# EAGLE schematic Resistor_Resistor (EAGLE 8.3.0), part 39 of 43
## Nets (continued)
N$147: R27401.2 R27402.2 R27403.2 R27404.2 R27405.2 R27406.2 R27407.2 R27408.2 R27409.2 R27410.2 R27411.2 R27412.2 R27413.2 R27414.2 R27415.2 R27416.2 R27417.2 R27418.2 R27419.2 R27420.2 R27421.2 R27422.2 R27423.2 R27424.2 R27425.2 R27426.2 R27427.2 R27428.2 R27429.2 R27430.2 R27431.2 R27432.2 R27433.2 R27434.2 R27435.2 R27436.2 R27437.2 R27438.2 R27439.2 R27440.2 R27441.2 R27442.2 R27443.2 R27444.2 R27445.2 R27446.2 R27447.2 R27448.2 R27449.2 R27450.2 R27451.2 R27452.2 R27453.2 R27454.2 R27455.2 R27456.2 R27457.2 R27458.2 R27459.2 R27460.2 R27461.2 R27462.2 R27463.2 R27464.2 R27465.2 R27466.2 R27467.2 R27468.2 R27469.2 R27470.2 R27471.2 R27472.2 R27473.2 R27474.2 R27475.2 R27476.2 R27477.2 R27478.2 R27479.2 R27480.2 R27481.2 R27482.2 R27483.2 R27484.2 R27485.2 R27486.2 R27487.2 R27488.2 R27489.2 R27490.2 R27491.2 R27492.2 R27493.2 R27494.2 R27495.2 R27496.2 R27497.2 R27498.2 R27499.2 R27500.2 R27501.2 R27502.2 R27503.2 R27504.2 R27505.2 R27506.2 R27507.2 R27508.2 R27509.2 R27510.2 R27511.2 R27512.2 R27513.2 R27514.2 R27515.2 R27516.2 R27517.2 R27518.2 R27519.2 R27520.2 R27521.2 R27522.2 R27523.2 R27524.2 R27525.2 R27526.2 R27527.2 R27528.2 R27529.2 R27530.2 R27531.2 R27532.2 R27533.2 R27534.2 R27535.2 R27536.2 R27537.2 R27538.2 R27539.2 R27540.2 R27541.2 R27542.2 R27543.2 R27544.2 R27545.2 R27546.2 R27547.2 R27548.2 R27549.2 R27550.2 R27551.2 R27552.2 R27553.2 R27554.2 R27555.2 R27556.2 R27557.2 R27558.2 R27559.2 R27560.2 R27561.2 R27562.2 R27563.2 R27564.2 R27565.2 R27566.2 R27567.2 R27568.2 R27569.2 R27570.2 R27571.2 R27572.2 R27573.2 R27574.2 R27575.2 R27576.2 R27577.2 R27578.2 R27579.2 R27580.2 R27581.2 R27582.2 R27583.2 R27584.2 R27585.2 R27586.2 R27587.2 R27588.2 R27589.2 R27590.2 R27591.2 R27592.2 R27593.2 R27594.2 R27595.2 R27596.2 R27597.2 R27598.2 R27599.2 R27600.2 R27601.1 R27602.1 R27603.1 R27604.1 R27605.1 R27606.1 R27607.1 R27608.1 R27609.1 R27610.1 R27611.1 R27612.1 R27613.1 R27614.1 R27615.1 R27616.1 R27617.1 R27618.1 R27619.1 R27620.1 R27621.1 R27622.1 R27623.1 R27624.1 R27625.1 R27626.1 R27627.1 R27628.1 R27629.1 R27630.1 R27631.1 R27632.1 R27633.1 R27634.1 R27635.1 R27636.1 R27637.1 R27638.1 R27639.1 R27640.1 R27641.1 R27642.1 R27643.1 R27644.1 R27645.1 R27646.1 R27647.1 R27648.1 R27649.1 R27650.1 R27651.1 R27652.1 R27653.1 R27654.1 R27655.1 R27656.1 R27657.1 R27658.1 R27659.1 R27660.1 R27661.1 R27662.1 R27663.1 R27664.1 R27665.1 R27666.1 R27667.1 R27668.1 R27669.1 R27670.1 R27671.1 R27672.1 R27673.1 R27674.1 R27675.1 R27676.1 R27677.1 R27678.1 R27679.1 R27680.1 R27681.1 R27682.1 R27683.1 R27684.1 R27685.1 R27686.1 R27687.1 R27688.1 R27689.1 R27690.1 R27691.1 R27692.1 R27693.1 R27694.1 R27695.1 R27696.1 R27697.1 R27698.1 R27699.1 R27700.1 R27701.1 R27702.1 R27703.1 R27704.1 R27705.1 R27706.1 R27707.1 R27708.1 R27709.1 R27710.1 R27711.1 R27712.1 R27713.1 R27714.1 R27715.1 R27716.1 R27717.1 R27718.1 R27719.1 R27720.1 R27721.1 R27722.1 R27723.1 R27724.1 R27725.1 R27726.1 R27727.1 R27728.1 R27729.1 R27730.1 R27731.1 R27732.1 R27733.1 R27734.1 R27735.1 R27736.1 R27737.1 R27738.1 R27739.1 R27740.1 R27741.1 R27742.1 R27743.1 R27744.1 R27745.1 R27746.1 R27747.1 R27748.1 R27749.1 R27750.1 R27751.1 R27752.1 R27753.1 R27754.1 R27755.1 R27756.1 R27757.1 R27758.1 R27759.1 R27760.1 R27761.1 R27762.1 R27763.1 R27764.1 R27765.1 R27766.1 R27767.1 R27768.1 R27769.1 R27770.1 R27771.1 R27772.1 R27773.1 R27774.1 R27775.1 R27776.1 R27777.1 R27778.1 R27779.1 R27780.1 R27781.1 R27782.1 R27783.1 R27784.1 R27785.1 R27786.1 R27787.1 R27788.1 R27789.1 R27790.1 R27791.1 R27792.1 R27793.1 R27794.1 R27795.1 R27796.1 R27797.1 R27798.1 R27799.1 R27800.1
N$148: R27601.2 R27602.2 R27603.2 R27604.2 R27605.2 R27606.2 R27607.2 R27608.2 R27609.2 R27610.2 R27611.2 R27612.2 R27613.2 R27614.2 R27615.2 R27616.2 R27617.2 R27618.2 R27619.2 R27620.2 R27621.2 R27622.2 R27623.2 R27624.2 R27625.2 R27626.2 R27627.2 R27628.2 R27629.2 R27630.2 R27631.2 R27632.2 R27633.2 R27634.2 R27635.2 R27636.2 R27637.2 R27638.2 R27639.2 R27640.2 R27641.2 R27642.2 R27643.2 R27644.2 R27645.2 R27646.2 R27647.2 R27648.2 R27649.2 R27650.2 R27651.2 R27652.2 R27653.2 R27654.2 R27655.2 R27656.2 R27657.2 R27658.2 R27659.2 R27660.2 R27661.2 R27662.2 R27663.2 R27664.2 R27665.2 R27666.2 R27667.2 R27668.2 R27669.2 R27670.2 R27671.2 R27672.2 R27673.2 R27674.2 R27675.2 R27676.2 R27677.2 R27678.2 R27679.2 R27680.2 R27681.2 R27682.2 R27683.2 R27684.2 R27685.2 R27686.2 R27687.2 R27688.2 R27689.2 R27690.2 R27691.2 R27692.2 R27693.2 R27694.2 R27695.2 R27696.2 R27697.2 R27698.2 R27699.2 R27700.2 R27701.2 R27702.2 R27703.2 R27704.2 R27705.2 R27706.2 R27707.2 R27708.2 R27709.2 R27710.2 R27711.2 R27712.2 R27713.2 R27714.2 R27715.2 R27716.2 R27717.2 R27718.2 R27719.2 R27720.2 R27721.2 R27722.2 R27723.2 R27724.2 R27725.2 R27726.2 R27727.2 R27728.2 R27729.2 R27730.2 R27731.2 R27732.2 R27733.2 R27734.2 R27735.2 R27736.2 R27737.2 R27738.2 R27739.2 R27740.2 R27741.2 R27742.2 R27743.2 R27744.2 R27745.2 R27746.2 R27747.2 R27748.2 R27749.2 R27750.2 R27751.2 R27752.2 R27753.2 R27754.2 R27755.2 R27756.2 R27757.2 R27758.2 R27759.2 R27760.2 R27761.2 R27762.2 R27763.2 R27764.2 R27765.2 R27766.2 R27767.2 R27768.2 R27769.2 R27770.2 R27771.2 R27772.2 R27773.2 R27774.2 R27775.2 R27776.2 R27777.2 R27778.2 R27779.2 R27780.2 R27781.2 R27782.2 R27783.2 R27784.2 R27785.2 R27786.2 R27787.2 R27788.2 R27789.2 R27790.2 R27791.2 R27792.2 R27793.2 R27794.2 R27795.2 R27796.2 R27797.2 R27798.2 R27799.2 R27800.2 R27801.1 R27802.1 R27803.1 R27804.1 R27805.1 R27806.1 R27807.1 R27808.1 R27809.1 R27810.1 R27811.1 R27812.1 R27813.1 R27814.1 R27815.1 R27816.1 R27817.1 R27818.1 R27819.1 R27820.1 R27821.1 R27822.1 R27823.1 R27824.1 R27825.1 R27826.1 R27827.1 R27828.1 R27829.1 R27830.1 R27831.1 R27832.1 R27833.1 R27834.1 R27835.1 R27836.1 R27837.1 R27838.1 R27839.1 R27840.1 R27841.1 R27842.1 R27843.1 R27844.1 R27845.1 R27846.1 R27847.1 R27848.1 R27849.1 R27850.1 R27851.1 R27852.1 R27853.1 R27854.1 R27855.1 R27856.1 R27857.1 R27858.1 R27859.1 R27860.1 R27861.1 R27862.1 R27863.1 R27864.1 R27865.1 R27866.1 R27867.1 R27868.1 R27869.1 R27870.1 R27871.1 R27872.1 R27873.1 R27874.1 R27875.1 R27876.1 R27877.1 R27878.1 R27879.1 R27880.1 R27881.1 R27882.1 R27883.1 R27884.1 R27885.1 R27886.1 R27887.1 R27888.1 R27889.1 R27890.1 R27891.1 R27892.1 R27893.1 R27894.1 R27895.1 R27896.1 R27897.1 R27898.1 R27899.1 R27900.1 R27901.1 R27902.1 R27903.1 R27904.1 R27905.1 R27906.1 R27907.1 R27908.1 R27909.1 R27910.1 R27911.1 R27912.1 R27913.1 R27914.1 R27915.1 R27916.1 R27917.1 R27918.1 R27919.1 R27920.1 R27921.1 R27922.1 R27923.1 R27924.1 R27925.1 R27926.1 R27927.1 R27928.1 R27929.1 R27930.1 R27931.1 R27932.1 R27933.1 R27934.1 R27935.1 R27936.1 R27937.1 R27938.1 R27939.1 R27940.1 R27941.1 R27942.1 R27943.1 R27944.1 R27945.1 R27946.1 R27947.1 R27948.1 R27949.1 R27950.1 R27951.1 R27952.1 R27953.1 R27954.1 R27955.1 R27956.1 R27957.1 R27958.1 R27959.1 R27960.1 R27961.1 R27962.1 R27963.1 R27964.1 R27965.1 R27966.1 R27967.1 R27968.1 R27969.1 R27970.1 R27971.1 R27972.1 R27973.1 R27974.1 R27975.1 R27976.1 R27977.1 R27978.1 R27979.1 R27980.1 R27981.1 R27982.1 R27983.1 R27984.1 R27985.1 R27986.1 R27987.1 R27988.1 R27989.1 R27990.1 R27991.1 R27992.1 R27993.1 R27994.1 R27995.1 R27996.1 R27997.1 R27998.1 R27999.1 R28000.1
N$149: R27801.2 R27802.2 R27803.2 R27804.2 R27805.2 R27806.2 R27807.2 R27808.2 R27809.2 R27810.2 R27811.2 R27812.2 R27813.2 R27814.2 R27815.2 R27816.2 R27817.2 R27818.2 R27819.2 R27820.2 R27821.2 R27822.2 R27823.2 R27824.2 R27825.2 R27826.2 R27827.2 R27828.2 R27829.2 R27830.2 R27831.2 R27832.2 R27833.2 R27834.2 R27835.2 R27836.2 R27837.2 R27838.2 R27839.2 R27840.2 R27841.2 R27842.2 R27843.2 R27844.2 R27845.2 R27846.2 R27847.2 R27848.2 R27849.2 R27850.2 R27851.2 R27852.2 R27853.2 R27854.2 R27855.2 R27856.2 R27857.2 R27858.2 R27859.2 R27860.2 R27861.2 R27862.2 R27863.2 R27864.2 R27865.2 R27866.2 R27867.2 R27868.2 R27869.2 R27870.2 R27871.2 R27872.2 R27873.2 R27874.2 R27875.2 R27876.2 R27877.2 R27878.2 R27879.2 R27880.2 R27881.2 R27882.2 R27883.2 R27884.2 R27885.2 R27886.2 R27887.2 R27888.2 R27889.2 R27890.2 R27891.2 R27892.2 R27893.2 R27894.2 R27895.2 R27896.2 R27897.2 R27898.2 R27899.2 R27900.2 R27901.2 R27902.2 R27903.2 R27904.2 R27905.2 R27906.2 R27907.2 R27908.2 R27909.2 R27910.2 R27911.2 R27912.2 R27913.2 R27914.2 R27915.2 R27916.2 R27917.2 R27918.2 R27919.2 R27920.2 R27921.2 R27922.2 R27923.2 R27924.2 R27925.2 R27926.2 R27927.2 R27928.2 R27929.2 R27930.2 R27931.2 R27932.2 R27933.2 R27934.2 R27935.2 R27936.2 R27937.2 R27938.2 R27939.2 R27940.2 R27941.2 R27942.2 R27943.2 R27944.2 R27945.2 R27946.2 R27947.2 R27948.2 R27949.2 R27950.2 R27951.2 R27952.2 R27953.2 R27954.2 R27955.2 R27956.2 R27957.2 R27958.2 R27959.2 R27960.2 R27961.2 R27962.2 R27963.2 R27964.2 R27965.2 R27966.2 R27967.2 R27968.2 R27969.2 R27970.2 R27971.2 R27972.2 R27973.2 R27974.2 R27975.2 R27976.2 R27977.2 R27978.2 R27979.2 R27980.2 R27981.2 R27982.2 R27983.2 R27984.2 R27985.2 R27986.2 R27987.2 R27988.2 R27989.2 R27990.2 R27991.2 R27992.2 R27993.2 R27994.2 R27995.2 R27996.2 R27997.2 R27998.2 R27999.2 R28000.2 R28001.1 R28002.1 R28003.1 R28004.1 R28005.1 R28006.1 R28007.1 R28008.1 R28009.1 R28010.1 R28011.1 R28012.1 R28013.1 R28014.1 R28015.1 R28016.1 R28017.1 R28018.1 R28019.1 R28020.1 R28021.1 R28022.1 R28023.1 R28024.1 R28025.1 R28026.1 R28027.1 R28028.1 R28029.1 R28030.1 R28031.1 R28032.1 R28033.1 R28034.1 R28035.1 R28036.1 R28037.1 R28038.1 R28039.1 R28040.1 R28041.1 R28042.1 R28043.1 R28044.1 R28045.1 R28046.1 R28047.1 R28048.1 R28049.1 R28050.1 R28051.1 R28052.1 R28053.1 R28054.1 R28055.1 R28056.1 R28057.1 R28058.1 R28059.1 R28060.1 R28061.1 R28062.1 R28063.1 R28064.1 R28065.1 R28066.1 R28067.1 R28068.1 R28069.1 R28070.1 R28071.1 R28072.1 R28073.1 R28074.1 R28075.1 R28076.1 R28077.1 R28078.1 R28079.1 R28080.1 R28081.1 R28082.1 R28083.1 R28084.1 R28085.1 R28086.1 R28087.1 R28088.1 R28089.1 R28090.1 R28091.1 R28092.1 R28093.1 R28094.1 R28095.1 R28096.1 R28097.1 R28098.1 R28099.1 R28100.1 R28101.1 R28102.1 R28103.1 R28104.1 R28105.1 R28106.1 R28107.1 R28108.1 R28109.1 R28110.1 R28111.1 R28112.1 R28113.1 R28114.1 R28115.1 R28116.1 R28117.1 R28118.1 R28119.1 R28120.1 R28121.1 R28122.1 R28123.1 R28124.1 R28125.1 R28126.1 R28127.1 R28128.1 R28129.1 R28130.1 R28131.1 R28132.1 R28133.1 R28134.1 R28135.1 R28136.1 R28137.1 R28138.1 R28139.1 R28140.1 R28141.1 R28142.1 R28143.1 R28144.1 R28145.1 R28146.1 R28147.1 R28148.1 R28149.1 R28150.1 R28151.1 R28152.1 R28153.1 R28154.1 R28155.1 R28156.1 R28157.1 R28158.1 R28159.1 R28160.1 R28161.1 R28162.1 R28163.1 R28164.1 R28165.1 R28166.1 R28167.1 R28168.1 R28169.1 R28170.1 R28171.1 R28172.1 R28173.1 R28174.1 R28175.1 R28176.1 R28177.1 R28178.1 R28179.1 R28180.1 R28181.1 R28182.1 R28183.1 R28184.1 R28185.1 R28186.1 R28187.1 R28188.1 R28189.1 R28190.1 R28191.1 R28192.1 R28193.1 R28194.1 R28195.1 R28196.1 R28197.1 R28198.1 R28199.1 R28200.1
N$150: R28001.2 R28002.2 R28003.2 R28004.2 R28005.2 R28006.2 R28007.2 R28008.2 R28009.2 R28010.2 R28011.2 R28012.2 R28013.2 R28014.2 R28015.2 R28016.2 R28017.2 R28018.2 R28019.2 R28020.2 R28021.2 R28022.2 R28023.2 R28024.2 R28025.2 R28026.2 R28027.2 R28028.2 R28029.2 R28030.2 R28031.2 R28032.2 R28033.2 R28034.2 R28035.2 R28036.2 R28037.2 R28038.2 R28039.2 R28040.2 R28041.2 R28042.2 R28043.2 R28044.2 R28045.2 R28046.2 R28047.2 R28048.2 R28049.2 R28050.2 R28051.2 R28052.2 R28053.2 R28054.2 R28055.2 R28056.2 R28057.2 R28058.2 R28059.2 R28060.2 R28061.2 R28062.2 R28063.2 R28064.2 R28065.2 R28066.2 R28067.2 R28068.2 R28069.2 R28070.2 R28071.2 R28072.2 R28073.2 R28074.2 R28075.2 R28076.2 R28077.2 R28078.2 R28079.2 R28080.2 R28081.2 R28082.2 R28083.2 R28084.2 R28085.2 R28086.2 R28087.2 R28088.2 R28089.2 R28090.2 R28091.2 R28092.2 R28093.2 R28094.2 R28095.2 R28096.2 R28097.2 R28098.2 R28099.2 R28100.2 R28101.2 R28102.2 R28103.2 R28104.2 R28105.2 R28106.2 R28107.2 R28108.2 R28109.2 R28110.2 R28111.2 R28112.2 R28113.2 R28114.2 R28115.2 R28116.2 R28117.2 R28118.2 R28119.2 R28120.2 R28121.2 R28122.2 R28123.2 R28124.2 R28125.2 R28126.2 R28127.2 R28128.2 R28129.2 R28130.2 R28131.2 R28132.2 R28133.2 R28134.2 R28135.2 R28136.2 R28137.2 R28138.2 R28139.2 R28140.2 R28141.2 R28142.2 R28143.2 R28144.2 R28145.2 R28146.2 R28147.2 R28148.2 R28149.2 R28150.2 R28151.2 R28152.2 R28153.2 R28154.2 R28155.2 R28156.2 R28157.2 R28158.2 R28159.2 R28160.2 R28161.2 R28162.2 R28163.2 R28164.2 R28165.2 R28166.2 R28167.2 R28168.2 R28169.2 R28170.2 R28171.2 R28172.2 R28173.2 R28174.2 R28175.2 R28176.2 R28177.2 R28178.2 R28179.2 R28180.2 R28181.2 R28182.2 R28183.2 R28184.2 R28185.2 R28186.2 R28187.2 R28188.2 R28189.2 R28190.2 R28191.2 R28192.2 R28193.2 R28194.2 R28195.2 R28196.2 R28197.2 R28198.2 R28199.2 R28200.2 R28201.1 R28202.1 R28203.1 R28204.1 R28205.1 R28206.1 R28207.1 R28208.1 R28209.1 R28210.1 R28211.1 R28212.1 R28213.1 R28214.1 R28215.1 R28216.1 R28217.1 R28218.1 R28219.1 R28220.1 R28221.1 R28222.1 R28223.1 R28224.1 R28225.1 R28226.1 R28227.1 R28228.1 R28229.1 R28230.1 R28231.1 R28232.1 R28233.1 R28234.1 R28235.1 R28236.1 R28237.1 R28238.1 R28239.1 R28240.1 R28241.1 R28242.1 R28243.1 R28244.1 R28245.1 R28246.1 R28247.1 R28248.1 R28249.1 R28250.1 R28251.1 R28252.1 R28253.1 R28254.1 R28255.1 R28256.1 R28257.1 R28258.1 R28259.1 R28260.1 R28261.1 R28262.1 R28263.1 R28264.1 R28265.1 R28266.1 R28267.1 R28268.1 R28269.1 R28270.1 R28271.1 R28272.1 R28273.1 R28274.1 R28275.1 R28276.1 R28277.1 R28278.1 R28279.1 R28280.1 R28281.1 R28282.1 R28283.1 R28284.1 R28285.1 R28286.1 R28287.1 R28288.1 R28289.1 R28290.1 R28291.1 R28292.1 R28293.1 R28294.1 R28295.1 R28296.1 R28297.1 R28298.1 R28299.1 R28300.1 R28301.1 R28302.1 R28303.1 R28304.1 R28305.1 R28306.1 R28307.1 R28308.1 R28309.1 R28310.1 R28311.1 R28312.1 R28313.1 R28314.1 R28315.1 R28316.1 R28317.1 R28318.1 R28319.1 R28320.1 R28321.1 R28322.1 R28323.1 R28324.1 R28325.1 R28326.1 R28327.1 R28328.1 R28329.1 R28330.1 R28331.1 R28332.1 R28333.1 R28334.1 R28335.1 R28336.1 R28337.1 R28338.1 R28339.1 R28340.1 R28341.1 R28342.1 R28343.1 R28344.1 R28345.1 R28346.1 R28347.1 R28348.1 R28349.1 R28350.1 R28351.1 R28352.1 R28353.1 R28354.1 R28355.1 R28356.1 R28357.1 R28358.1 R28359.1 R28360.1 R28361.1 R28362.1 R28363.1 R28364.1 R28365.1 R28366.1 R28367.1 R28368.1 R28369.1 R28370.1 R28371.1 R28372.1 R28373.1 R28374.1 R28375.1 R28376.1 R28377.1 R28378.1 R28379.1 R28380.1 R28381.1 R28382.1 R28383.1 R28384.1 R28385.1 R28386.1 R28387.1 R28388.1 R28389.1 R28390.1 R28391.1 R28392.1 R28393.1 R28394.1 R28395.1 R28396.1 R28397.1 R28398.1 R28399.1 R28400.1
N$151: R28201.2 R28202.2 R28203.2 R28204.2 R28205.2 R28206.2 R28207.2 R28208.2 R28209.2 R28210.2 R28211.2 R28212.2 R28213.2 R28214.2 R28215.2 R28216.2 R28217.2 R28218.2 R28219.2 R28220.2 R28221.2 R28222.2 R28223.2 R28224.2 R28225.2 R28226.2 R28227.2 R28228.2 R28229.2 R28230.2 R28231.2 R28232.2 R28233.2 R28234.2 R28235.2 R28236.2 R28237.2 R28238.2 R28239.2 R28240.2 R28241.2 R28242.2 R28243.2 R28244.2 R28245.2 R28246.2 R28247.2 R28248.2 R28249.2 R28250.2 R28251.2 R28252.2 R28253.2 R28254.2 R28255.2 R28256.2 R28257.2 R28258.2 R28259.2 R28260.2 R28261.2 R28262.2 R28263.2 R28264.2 R28265.2 R28266.2 R28267.2 R28268.2 R28269.2 R28270.2 R28271.2 R28272.2 R28273.2 R28274.2 R28275.2 R28276.2 R28277.2 R28278.2 R28279.2 R28280.2 R28281.2 R28282.2 R28283.2 R28284.2 R28285.2 R28286.2 R28287.2 R28288.2 R28289.2 R28290.2 R28291.2 R28292.2 R28293.2 R28294.2 R28295.2 R28296.2 R28297.2 R28298.2 R28299.2 R28300.2 R28301.2 R28302.2 R28303.2 R28304.2 R28305.2 R28306.2 R28307.2 R28308.2 R28309.2 R28310.2 R28311.2 R28312.2 R28313.2 R28314.2 R28315.2 R28316.2 R28317.2 R28318.2 R28319.2 R28320.2 R28321.2 R28322.2 R28323.2 R28324.2 R28325.2 R28326.2 R28327.2 R28328.2 R28329.2 R28330.2 R28331.2 R28332.2 R28333.2 R28334.2 R28335.2 R28336.2 R28337.2 R28338.2 R28339.2 R28340.2 R28341.2 R28342.2 R28343.2 R28344.2 R28345.2 R28346.2 R28347.2 R28348.2 R28349.2 R28350.2 R28351.2 R28352.2 R28353.2 R28354.2 R28355.2 R28356.2 R28357.2 R28358.2 R28359.2 R28360.2 R28361.2 R28362.2 R28363.2 R28364.2 R28365.2 R28366.2 R28367.2 R28368.2 R28369.2 R28370.2 R28371.2 R28372.2 R28373.2 R28374.2 R28375.2 R28376.2 R28377.2 R28378.2 R28379.2 R28380.2 R28381.2 R28382.2 R28383.2 R28384.2 R28385.2 R28386.2 R28387.2 R28388.2 R28389.2 R28390.2 R28391.2 R28392.2 R28393.2 R28394.2 R28395.2 R28396.2 R28397.2 R28398.2 R28399.2 R28400.2 R28401.1 R28402.1 R28403.1 R28404.1 R28405.1 R28406.1 R28407.1 R28408.1 R28409.1 R28410.1 R28411.1 R28412.1 R28413.1 R28414.1 R28415.1 R28416.1 R28417.1 R28418.1 R28419.1 R28420.1 R28421.1 R28422.1 R28423.1 R28424.1 R28425.1 R28426.1 R28427.1 R28428.1 R28429.1 R28430.1 R28431.1 R28432.1 R28433.1 R28434.1 R28435.1 R28436.1 R28437.1 R28438.1 R28439.1 R28440.1 R28441.1 R28442.1 R28443.1 R28444.1 R28445.1 R28446.1 R28447.1 R28448.1 R28449.1 R28450.1 R28451.1 R28452.1 R28453.1 R28454.1 R28455.1 R28456.1 R28457.1 R28458.1 R28459.1 R28460.1 R28461.1 R28462.1 R28463.1 R28464.1 R28465.1 R28466.1 R28467.1 R28468.1 R28469.1 R28470.1 R28471.1 R28472.1 R28473.1 R28474.1 R28475.1 R28476.1 R28477.1 R28478.1 R28479.1 R28480.1 R28481.1 R28482.1 R28483.1 R28484.1 R28485.1 R28486.1 R28487.1 R28488.1 R28489.1 R28490.1 R28491.1 R28492.1 R28493.1 R28494.1 R28495.1 R28496.1 R28497.1 R28498.1 R28499.1 R28500.1 R28501.1 R28502.1 R28503.1 R28504.1 R28505.1 R28506.1 R28507.1 R28508.1 R28509.1 R28510.1 R28511.1 R28512.1 R28513.1 R28514.1 R28515.1 R28516.1 R28517.1 R28518.1 R28519.1 R28520.1 R28521.1 R28522.1 R28523.1 R28524.1 R28525.1 R28526.1 R28527.1 R28528.1 R28529.1 R28530.1 R28531.1 R28532.1 R28533.1 R28534.1 R28535.1 R28536.1 R28537.1 R28538.1 R28539.1 R28540.1 R28541.1 R28542.1 R28543.1 R28544.1 R28545.1 R28546.1 R28547.1 R28548.1 R28549.1 R28550.1 R28551.1 R28552.1 R28553.1 R28554.1 R28555.1 R28556.1 R28557.1 R28558.1 R28559.1 R28560.1 R28561.1 R28562.1 R28563.1 R28564.1 R28565.1 R28566.1 R28567.1 R28568.1 R28569.1 R28570.1 R28571.1 R28572.1 R28573.1 R28574.1 R28575.1 R28576.1 R28577.1 R28578.1 R28579.1 R28580.1 R28581.1 R28582.1 R28583.1 R28584.1 R28585.1 R28586.1 R28587.1 R28588.1 R28589.1 R28590.1 R28591.1 R28592.1 R28593.1 R28594.1 R28595.1 R28596.1 R28597.1 R28598.1 R28599.1 R28600.1
N$152: R28401.2 R28402.2 R28403.2 R28404.2 R28405.2 R28406.2 R28407.2 R28408.2 R28409.2 R28410.2 R28411.2 R28412.2 R28413.2 R28414.2 R28415.2 R28416.2 R28417.2 R28418.2 R28419.2 R28420.2 R28421.2 R28422.2 R28423.2 R28424.2 R28425.2 R28426.2 R28427.2 R28428.2 R28429.2 R28430.2 R28431.2 R28432.2 R28433.2 R28434.2 R28435.2 R28436.2 R28437.2 R28438.2 R28439.2 R28440.2 R28441.2 R28442.2 R28443.2 R28444.2 R28445.2 R28446.2 R28447.2 R28448.2 R28449.2 R28450.2 R28451.2 R28452.2 R28453.2 R28454.2 R28455.2 R28456.2 R28457.2 R28458.2 R28459.2 R28460.2 R28461.2 R28462.2 R28463.2 R28464.2 R28465.2 R28466.2 R28467.2 R28468.2 R28469.2 R28470.2 R28471.2 R28472.2 R28473.2 R28474.2 R28475.2 R28476.2 R28477.2 R28478.2 R28479.2 R28480.2 R28481.2 R28482.2 R28483.2 R28484.2 R28485.2 R28486.2 R28487.2 R28488.2 R28489.2 R28490.2 R28491.2 R28492.2 R28493.2 R28494.2 R28495.2 R28496.2 R28497.2 R28498.2 R28499.2 R28500.2 R28501.2 R28502.2 R28503.2 R28504.2 R28505.2 R28506.2 R28507.2 R28508.2 R28509.2 R28510.2 R28511.2 R28512.2 R28513.2 R28514.2 R28515.2 R28516.2 R28517.2 R28518.2 R28519.2 R28520.2 R28521.2 R28522.2 R28523.2 R28524.2 R28525.2 R28526.2 R28527.2 R28528.2 R28529.2 R28530.2 R28531.2 R28532.2 R28533.2 R28534.2 R28535.2 R28536.2 R28537.2 R28538.2 R28539.2 R28540.2 R28541.2 R28542.2 R28543.2 R28544.2 R28545.2 R28546.2 R28547.2 R28548.2 R28549.2 R28550.2 R28551.2 R28552.2 R28553.2 R28554.2 R28555.2 R28556.2 R28557.2 R28558.2 R28559.2 R28560.2 R28561.2 R28562.2 R28563.2 R28564.2 R28565.2 R28566.2 R28567.2 R28568.2 R28569.2 R28570.2 R28571.2 R28572.2 R28573.2 R28574.2 R28575.2 R28576.2 R28577.2 R28578.2 R28579.2 R28580.2 R28581.2 R28582.2 R28583.2 R28584.2 R28585.2 R28586.2 R28587.2 R28588.2 R28589.2 R28590.2 R28591.2 R28592.2 R28593.2 R28594.2 R28595.2 R28596.2 R28597.2 R28598.2 R28599.2 R28600.2 R28601.1 R28602.1 R28603.1 R28604.1 R28605.1 R28606.1 R28607.1 R28608.1 R28609.1 R28610.1 R28611.1 R28612.1 R28613.1 R28614.1 R28615.1 R28616.1 R28617.1 R28618.1 R28619.1 R28620.1 R28621.1 R28622.1 R28623.1 R28624.1 R28625.1 R28626.1 R28627.1 R28628.1 R28629.1 R28630.1 R28631.1 R28632.1 R28633.1 R28634.1 R28635.1 R28636.1 R28637.1 R28638.1 R28639.1 R28640.1 R28641.1 R28642.1 R28643.1 R28644.1 R28645.1 R28646.1 R28647.1 R28648.1 R28649.1 R28650.1 R28651.1 R28652.1 R28653.1 R28654.1 R28655.1 R28656.1 R28657.1 R28658.1 R28659.1 R28660.1 R28661.1 R28662.1 R28663.1 R28664.1 R28665.1 R28666.1 R28667.1 R28668.1 R28669.1 R28670.1 R28671.1 R28672.1 R28673.1 R28674.1 R28675.1 R28676.1 R28677.1 R28678.1 R28679.1 R28680.1 R28681.1 R28682.1 R28683.1 R28684.1 R28685.1 R28686.1 R28687.1 R28688.1 R28689.1 R28690.1 R28691.1 R28692.1 R28693.1 R28694.1 R28695.1 R28696.1 R28697.1 R28698.1 R28699.1 R28700.1 R28701.1 R28702.1 R28703.1 R28704.1 R28705.1 R28706.1 R28707.1 R28708.1 R28709.1 R28710.1 R28711.1 R28712.1 R28713.1 R28714.1 R28715.1 R28716.1 R28717.1 R28718.1 R28719.1 R28720.1 R28721.1 R28722.1 R28723.1 R28724.1 R28725.1 R28726.1 R28727.1 R28728.1 R28729.1 R28730.1 R28731.1 R28732.1 R28733.1 R28734.1 R28735.1 R28736.1 R28737.1 R28738.1 R28739.1 R28740.1 R28741.1 R28742.1 R28743.1 R28744.1 R28745.1 R28746.1 R28747.1 R28748.1 R28749.1 R28750.1 R28751.1 R28752.1 R28753.1 R28754.1 R28755.1 R28756.1 R28757.1 R28758.1 R28759.1 R28760.1 R28761.1 R28762.1 R28763.1 R28764.1 R28765.1 R28766.1 R28767.1 R28768.1 R28769.1 R28770.1 R28771.1 R28772.1 R28773.1 R28774.1 R28775.1 R28776.1 R28777.1 R28778.1 R28779.1 R28780.1 R28781.1 R28782.1 R28783.1 R28784.1 R28785.1 R28786.1 R28787.1 R28788.1 R28789.1 R28790.1 R28791.1 R28792.1 R28793.1 R28794.1 R28795.1 R28796.1 R28797.1 R28798.1 R28799.1 R28800.1
N$153: R28601.2 R28602.2 R28603.2 R28604.2 R28605.2 R28606.2 R28607.2 R28608.2 R28609.2 R28610.2 R28611.2 R28612.2 R28613.2 R28614.2 R28615.2 R28616.2 R28617.2 R28618.2 R28619.2 R28620.2 R28621.2 R28622.2 R28623.2 R28624.2 R28625.2 R28626.2 R28627.2 R28628.2 R28629.2 R28630.2 R28631.2 R28632.2 R28633.2 R28634.2 R28635.2 R28636.2 R28637.2 R28638.2 R28639.2 R28640.2 R28641.2 R28642.2 R28643.2 R28644.2 R28645.2 R28646.2 R28647.2 R28648.2 R28649.2 R28650.2 R28651.2 R28652.2 R28653.2 R28654.2 R28655.2 R28656.2 R28657.2 R28658.2 R28659.2 R28660.2 R28661.2 R28662.2 R28663.2 R28664.2 R28665.2 R28666.2 R28667.2 R28668.2 R28669.2 R28670.2 R28671.2 R28672.2 R28673.2 R28674.2 R28675.2 R28676.2 R28677.2 R28678.2 R28679.2 R28680.2 R28681.2 R28682.2 R28683.2 R28684.2 R28685.2 R28686.2 R28687.2 R28688.2 R28689.2 R28690.2 R28691.2 R28692.2 R28693.2 R28694.2 R28695.2 R28696.2 R28697.2 R28698.2 R28699.2 R28700.2 R28701.2 R28702.2 R28703.2 R28704.2 R28705.2 R28706.2 R28707.2 R28708.2 R28709.2 R28710.2 R28711.2 R28712.2 R28713.2 R28714.2 R28715.2 R28716.2 R28717.2 R28718.2 R28719.2 R28720.2 R28721.2 R28722.2 R28723.2 R28724.2 R28725.2 R28726.2 R28727.2 R28728.2 R28729.2 R28730.2 R28731.2 R28732.2 R28733.2 R28734.2 R28735.2 R28736.2 R28737.2 R28738.2 R28739.2 R28740.2 R28741.2 R28742.2 R28743.2 R28744.2 R28745.2 R28746.2 R28747.2 R28748.2 R28749.2 R28750.2 R28751.2 R28752.2 R28753.2 R28754.2 R28755.2 R28756.2 R28757.2 R28758.2 R28759.2 R28760.2 R28761.2 R28762.2 R28763.2 R28764.2 R28765.2 R28766.2 R28767.2 R28768.2 R28769.2 R28770.2 R28771.2 R28772.2 R28773.2 R28774.2 R28775.2 R28776.2 R28777.2 R28778.2 R28779.2 R28780.2 R28781.2 R28782.2 R28783.2 R28784.2 R28785.2 R28786.2 R28787.2 R28788.2 R28789.2 R28790.2 R28791.2 R28792.2 R28793.2 R28794.2 R28795.2 R28796.2 R28797.2 R28798.2 R28799.2 R28800.2 R28801.1 R28802.1 R28803.1 R28804.1 R28805.1 R28806.1 R28807.1 R28808.1 R28809.1 R28810.1 R28811.1 R28812.1 R28813.1 R28814.1 R28815.1 R28816.1 R28817.1 R28818.1 R28819.1 R28820.1 R28821.1 R28822.1 R28823.1 R28824.1 R28825.1 R28826.1 R28827.1 R28828.1 R28829.1 R28830.1 R28831.1 R28832.1 R28833.1 R28834.1 R28835.1 R28836.1 R28837.1 R28838.1 R28839.1 R28840.1 R28841.1 R28842.1 R28843.1 R28844.1 R28845.1 R28846.1 R28847.1 R28848.1 R28849.1 R28850.1 R28851.1 R28852.1 R28853.1 R28854.1 R28855.1 R28856.1 R28857.1 R28858.1 R28859.1 R28860.1 R28861.1 R28862.1 R28863.1 R28864.1 R28865.1 R28866.1 R28867.1 R28868.1 R28869.1 R28870.1 R28871.1 R28872.1 R28873.1 R28874.1 R28875.1 R28876.1 R28877.1 R28878.1 R28879.1 R28880.1 R28881.1 R28882.1 R28883.1 R28884.1 R28885.1 R28886.1 R28887.1 R28888.1 R28889.1 R28890.1 R28891.1 R28892.1 R28893.1 R28894.1 R28895.1 R28896.1 R28897.1 R28898.1 R28899.1 R28900.1 R28901.1 R28902.1 R28903.1 R28904.1 R28905.1 R28906.1 R28907.1 R28908.1 R28909.1 R28910.1 R28911.1 R28912.1 R28913.1 R28914.1 R28915.1 R28916.1 R28917.1 R28918.1 R28919.1 R28920.1 R28921.1 R28922.1 R28923.1 R28924.1 R28925.1 R28926.1 R28927.1 R28928.1 R28929.1 R28930.1 R28931.1 R28932.1 R28933.1 R28934.1 R28935.1 R28936.1 R28937.1 R28938.1 R28939.1 R28940.1 R28941.1 R28942.1 R28943.1 R28944.1 R28945.1 R28946.1 R28947.1 R28948.1 R28949.1 R28950.1 R28951.1 R28952.1 R28953.1 R28954.1 R28955.1 R28956.1 R28957.1 R28958.1 R28959.1 R28960.1 R28961.1 R28962.1 R28963.1 R28964.1 R28965.1 R28966.1 R28967.1 R28968.1 R28969.1 R28970.1 R28971.1 R28972.1 R28973.1 R28974.1 R28975.1 R28976.1 R28977.1 R28978.1 R28979.1 R28980.1 R28981.1 R28982.1 R28983.1 R28984.1 R28985.1 R28986.1 R28987.1 R28988.1 R28989.1 R28990.1 R28991.1 R28992.1 R28993.1 R28994.1 R28995.1 R28996.1 R28997.1 R28998.1 R28999.1 R29000.1
N$154: R28801.2 R28802.2 R28803.2 R28804.2 R28805.2 R28806.2 R28807.2 R28808.2 R28809.2 R28810.2 R28811.2 R28812.2 R28813.2 R28814.2 R28815.2 R28816.2 R28817.2 R28818.2 R28819.2 R28820.2 R28821.2 R28822.2 R28823.2 R28824.2 R28825.2 R28826.2 R28827.2 R28828.2 R28829.2 R28830.2 R28831.2 R28832.2 R28833.2 R28834.2 R28835.2 R28836.2 R28837.2 R28838.2 R28839.2 R28840.2 R28841.2 R28842.2 R28843.2 R28844.2 R28845.2 R28846.2 R28847.2 R28848.2 R28849.2 R28850.2 R28851.2 R28852.2 R28853.2 R28854.2 R28855.2 R28856.2 R28857.2 R28858.2 R28859.2 R28860.2 R28861.2 R28862.2 R28863.2 R28864.2 R28865.2 R28866.2 R28867.2 R28868.2 R28869.2 R28870.2 R28871.2 R28872.2 R28873.2 R28874.2 R28875.2 R28876.2 R28877.2 R28878.2 R28879.2 R28880.2 R28881.2 R28882.2 R28883.2 R28884.2 R28885.2 R28886.2 R28887.2 R28888.2 R28889.2 R28890.2 R28891.2 R28892.2 R28893.2 R28894.2 R28895.2 R28896.2 R28897.2 R28898.2 R28899.2 R28900.2 R28901.2 R28902.2 R28903.2 R28904.2 R28905.2 R28906.2 R28907.2 R28908.2 R28909.2 R28910.2 R28911.2 R28912.2 R28913.2 R28914.2 R28915.2 R28916.2 R28917.2 R28918.2 R28919.2 R28920.2 R28921.2 R28922.2 R28923.2 R28924.2 R28925.2 R28926.2 R28927.2 R28928.2 R28929.2 R28930.2 R28931.2 R28932.2 R28933.2 R28934.2 R28935.2 R28936.2 R28937.2 R28938.2 R28939.2 R28940.2 R28941.2 R28942.2 R28943.2 R28944.2 R28945.2 R28946.2 R28947.2 R28948.2 R28949.2 R28950.2 R28951.2 R28952.2 R28953.2 R28954.2 R28955.2 R28956.2 R28957.2 R28958.2 R28959.2 R28960.2 R28961.2 R28962.2 R28963.2 R28964.2 R28965.2 R28966.2 R28967.2 R28968.2 R28969.2 R28970.2 R28971.2 R28972.2 R28973.2 R28974.2 R28975.2 R28976.2 R28977.2 R28978.2 R28979.2 R28980.2 R28981.2 R28982.2 R28983.2 R28984.2 R28985.2 R28986.2 R28987.2 R28988.2 R28989.2 R28990.2 R28991.2 R28992.2 R28993.2 R28994.2 R28995.2 R28996.2 R28997.2 R28998.2 R28999.2 R29000.2 R29001.1 R29002.1 R29003.1 R29004.1 R29005.1 R29006.1 R29007.1 R29008.1 R29009.1 R29010.1 R29011.1 R29012.1 R29013.1 R29014.1 R29015.1 R29016.1 R29017.1 R29018.1 R29019.1 R29020.1 R29021.1 R29022.1 R29023.1 R29024.1 R29025.1 R29026.1 R29027.1 R29028.1 R29029.1 R29030.1 R29031.1 R29032.1 R29033.1 R29034.1 R29035.1 R29036.1 R29037.1 R29038.1 R29039.1 R29040.1 R29041.1 R29042.1 R29043.1 R29044.1 R29045.1 R29046.1 R29047.1 R29048.1 R29049.1 R29050.1 R29051.1 R29052.1 R29053.1 R29054.1 R29055.1 R29056.1 R29057.1 R29058.1 R29059.1 R29060.1 R29061.1 R29062.1 R29063.1 R29064.1 R29065.1 R29066.1 R29067.1 R29068.1 R29069.1 R29070.1 R29071.1 R29072.1 R29073.1 R29074.1 R29075.1 R29076.1 R29077.1 R29078.1 R29079.1 R29080.1 R29081.1 R29082.1 R29083.1 R29084.1 R29085.1 R29086.1 R29087.1 R29088.1 R29089.1 R29090.1 R29091.1 R29092.1 R29093.1 R29094.1 R29095.1 R29096.1 R29097.1 R29098.1 R29099.1 R29100.1 R29101.1 R29102.1 R29103.1 R29104.1 R29105.1 R29106.1 R29107.1 R29108.1 R29109.1 R29110.1 R29111.1 R29112.1 R29113.1 R29114.1 R29115.1 R29116.1 R29117.1 R29118.1 R29119.1 R29120.1 R29121.1 R29122.1 R29123.1 R29124.1 R29125.1 R29126.1 R29127.1 R29128.1 R29129.1 R29130.1 R29131.1 R29132.1 R29133.1 R29134.1 R29135.1 R29136.1 R29137.1 R29138.1 R29139.1 R29140.1 R29141.1 R29142.1 R29143.1 R29144.1 R29145.1 R29146.1 R29147.1 R29148.1 R29149.1 R29150.1 R29151.1 R29152.1 R29153.1 R29154.1 R29155.1 R29156.1 R29157.1 R29158.1 R29159.1 R29160.1 R29161.1 R29162.1 R29163.1 R29164.1 R29165.1 R29166.1 R29167.1 R29168.1 R29169.1 R29170.1 R29171.1 R29172.1 R29173.1 R29174.1 R29175.1 R29176.1 R29177.1 R29178.1 R29179.1 R29180.1 R29181.1 R29182.1 R29183.1 R29184.1 R29185.1 R29186.1 R29187.1 R29188.1 R29189.1 R29190.1 R29191.1 R29192.1 R29193.1 R29194.1 R29195.1 R29196.1 R29197.1 R29198.1 R29199.1 R29200.1
N$155: R29001.2 R29002.2 R29003.2 R29004.2 R29005.2 R29006.2 R29007.2 R29008.2 R29009.2 R29010.2 R29011.2 R29012.2 R29013.2 R29014.2 R29015.2 R29016.2 R29017.2 R29018.2 R29019.2 R29020.2 R29021.2 R29022.2 R29023.2 R29024.2 R29025.2 R29026.2 R29027.2 R29028.2 R29029.2 R29030.2 R29031.2 R29032.2 R29033.2 R29034.2 R29035.2 R29036.2 R29037.2 R29038.2 R29039.2 R29040.2 R29041.2 R29042.2 R29043.2 R29044.2 R29045.2 R29046.2 R29047.2 R29048.2 R29049.2 R29050.2 R29051.2 R29052.2 R29053.2 R29054.2 R29055.2 R29056.2 R29057.2 R29058.2 R29059.2 R29060.2 R29061.2 R29062.2 R29063.2 R29064.2 R29065.2 R29066.2 R29067.2 R29068.2 R29069.2 R29070.2 R29071.2 R29072.2 R29073.2 R29074.2 R29075.2 R29076.2 R29077.2 R29078.2 R29079.2 R29080.2 R29081.2 R29082.2 R29083.2 R29084.2 R29085.2 R29086.2 R29087.2 R29088.2 R29089.2 R29090.2 R29091.2 R29092.2 R29093.2 R29094.2 R29095.2 R29096.2 R29097.2 R29098.2 R29099.2 R29100.2 R29101.2 R29102.2 R29103.2 R29104.2 R29105.2 R29106.2 R29107.2 R29108.2 R29109.2 R29110.2 R29111.2 R29112.2 R29113.2 R29114.2 R29115.2 R29116.2 R29117.2 R29118.2 R29119.2 R29120.2 R29121.2 R29122.2 R29123.2 R29124.2 R29125.2 R29126.2 R29127.2 R29128.2 R29129.2 R29130.2 R29131.2 R29132.2 R29133.2 R29134.2 R29135.2 R29136.2 R29137.2 R29138.2 R29139.2 R29140.2 R29141.2 R29142.2 R29143.2 R29144.2 R29145.2 R29146.2 R29147.2 R29148.2 R29149.2 R29150.2 R29151.2 R29152.2 R29153.2 R29154.2 R29155.2 R29156.2 R29157.2 R29158.2 R29159.2 R29160.2 R29161.2 R29162.2 R29163.2 R29164.2 R29165.2 R29166.2 R29167.2 R29168.2 R29169.2 R29170.2 R29171.2 R29172.2 R29173.2 R29174.2 R29175.2 R29176.2 R29177.2 R29178.2 R29179.2 R29180.2 R29181.2 R29182.2 R29183.2 R29184.2 R29185.2 R29186.2 R29187.2 R29188.2 R29189.2 R29190.2 R29191.2 R29192.2 R29193.2 R29194.2 R29195.2 R29196.2 R29197.2 R29198.2 R29199.2 R29200.2 R29201.1 R29202.1 R29203.1 R29204.1 R29205.1 R29206.1 R29207.1 R29208.1 R29209.1 R29210.1 R29211.1 R29212.1 R29213.1 R29214.1 R29215.1 R29216.1 R29217.1 R29218.1 R29219.1 R29220.1 R29221.1 R29222.1 R29223.1 R29224.1 R29225.1 R29226.1 R29227.1 R29228.1 R29229.1 R29230.1 R29231.1 R29232.1 R29233.1 R29234.1 R29235.1 R29236.1 R29237.1 R29238.1 R29239.1 R29240.1 R29241.1 R29242.1 R29243.1 R29244.1 R29245.1 R29246.1 R29247.1 R29248.1 R29249.1 R29250.1 R29251.1 R29252.1 R29253.1 R29254.1 R29255.1 R29256.1 R29257.1 R29258.1 R29259.1 R29260.1 R29261.1 R29262.1 R29263.1 R29264.1 R29265.1 R29266.1 R29267.1 R29268.1 R29269.1 R29270.1 R29271.1 R29272.1 R29273.1 R29274.1 R29275.1 R29276.1 R29277.1 R29278.1 R29279.1 R29280.1 R29281.1 R29282.1 R29283.1 R29284.1 R29285.1 R29286.1 R29287.1 R29288.1 R29289.1 R29290.1 R29291.1 R29292.1 R29293.1 R29294.1 R29295.1 R29296.1 R29297.1 R29298.1 R29299.1 R29300.1 R29301.1 R29302.1 R29303.1 R29304.1 R29305.1 R29306.1 R29307.1 R29308.1 R29309.1 R29310.1 R29311.1 R29312.1 R29313.1 R29314.1 R29315.1 R29316.1 R29317.1 R29318.1 R29319.1 R29320.1 R29321.1 R29322.1 R29323.1 R29324.1 R29325.1 R29326.1 R29327.1 R29328.1 R29329.1 R29330.1 R29331.1 R29332.1 R29333.1 R29334.1 R29335.1 R29336.1 R29337.1 R29338.1 R29339.1 R29340.1 R29341.1 R29342.1 R29343.1 R29344.1 R29345.1 R29346.1 R29347.1 R29348.1 R29349.1 R29350.1 R29351.1 R29352.1 R29353.1 R29354.1 R29355.1 R29356.1 R29357.1 R29358.1 R29359.1 R29360.1 R29361.1 R29362.1 R29363.1 R29364.1 R29365.1 R29366.1 R29367.1 R29368.1 R29369.1 R29370.1 R29371.1 R29372.1 R29373.1 R29374.1 R29375.1 R29376.1 R29377.1 R29378.1 R29379.1 R29380.1 R29381.1 R29382.1 R29383.1 R29384.1 R29385.1 R29386.1 R29387.1 R29388.1 R29389.1 R29390.1 R29391.1 R29392.1 R29393.1 R29394.1 R29395.1 R29396.1 R29397.1 R29398.1 R29399.1 R29400.1
N$156: R29201.2 R29202.2 R29203.2 R29204.2 R29205.2 R29206.2 R29207.2 R29208.2 R29209.2 R29210.2 R29211.2 R29212.2 R29213.2 R29214.2 R29215.2 R29216.2 R29217.2 R29218.2 R29219.2 R29220.2 R29221.2 R29222.2 R29223.2 R29224.2 R29225.2 R29226.2 R29227.2 R29228.2 R29229.2 R29230.2 R29231.2 R29232.2 R29233.2 R29234.2 R29235.2 R29236.2 R29237.2 R29238.2 R29239.2 R29240.2 R29241.2 R29242.2 R29243.2 R29244.2 R29245.2 R29246.2 R29247.2 R29248.2 R29249.2 R29250.2 R29251.2 R29252.2 R29253.2 R29254.2 R29255.2 R29256.2 R29257.2 R29258.2 R29259.2 R29260.2 R29261.2 R29262.2 R29263.2 R29264.2 R29265.2 R29266.2 R29267.2 R29268.2 R29269.2 R29270.2 R29271.2 R29272.2 R29273.2 R29274.2 R29275.2 R29276.2 R29277.2 R29278.2 R29279.2 R29280.2 R29281.2 R29282.2 R29283.2 R29284.2 R29285.2 R29286.2 R29287.2 R29288.2 R29289.2 R29290.2 R29291.2 R29292.2 R29293.2 R29294.2 R29295.2 R29296.2 R29297.2 R29298.2 R29299.2 R29300.2 R29301.2 R29302.2 R29303.2 R29304.2 R29305.2 R29306.2 R29307.2 R29308.2 R29309.2 R29310.2 R29311.2 R29312.2 R29313.2 R29314.2 R29315.2 R29316.2 R29317.2 R29318.2 R29319.2 R29320.2 R29321.2 R29322.2 R29323.2 R29324.2 R29325.2 R29326.2 R29327.2 R29328.2 R29329.2 R29330.2 R29331.2 R29332.2 R29333.2 R29334.2 R29335.2 R29336.2 R29337.2 R29338.2 R29339.2 R29340.2 R29341.2 R29342.2 R29343.2 R29344.2 R29345.2 R29346.2 R29347.2 R29348.2 R29349.2 R29350.2 R29351.2 R29352.2 R29353.2 R29354.2 R29355.2 R29356.2 R29357.2 R29358.2 R29359.2 R29360.2 R29361.2 R29362.2 R29363.2 R29364.2 R29365.2 R29366.2 R29367.2 R29368.2 R29369.2 R29370.2 R29371.2 R29372.2 R29373.2 R29374.2 R29375.2 R29376.2 R29377.2 R29378.2 R29379.2 R29380.2 R29381.2 R29382.2 R29383.2 R29384.2 R29385.2 R29386.2 R29387.2 R29388.2 R29389.2 R29390.2 R29391.2 R29392.2 R29393.2 R29394.2 R29395.2 R29396.2 R29397.2 R29398.2 R29399.2 R29400.2 R29401.1 R29402.1 R29403.1 R29404.1 R29405.1 R29406.1 R29407.1 R29408.1 R29409.1 R29410.1 R29411.1 R29412.1 R29413.1 R29414.1 R29415.1 R29416.1 R29417.1 R29418.1 R29419.1 R29420.1 R29421.1 R29422.1 R29423.1 R29424.1 R29425.1 R29426.1 R29427.1 R29428.1 R29429.1 R29430.1 R29431.1 R29432.1 R29433.1 R29434.1 R29435.1 R29436.1 R29437.1 R29438.1 R29439.1 R29440.1 R29441.1 R29442.1 R29443.1 R29444.1 R29445.1 R29446.1 R29447.1 R29448.1 R29449.1 R29450.1 R29451.1 R29452.1 R29453.1 R29454.1 R29455.1 R29456.1 R29457.1 R29458.1 R29459.1 R29460.1 R29461.1 R29462.1 R29463.1 R29464.1 R29465.1 R29466.1 R29467.1 R29468.1 R29469.1 R29470.1 R29471.1 R29472.1 R29473.1 R29474.1 R29475.1 R29476.1 R29477.1 R29478.1 R29479.1 R29480.1 R29481.1 R29482.1 R29483.1 R29484.1 R29485.1 R29486.1 R29487.1 R29488.1 R29489.1 R29490.1 R29491.1 R29492.1 R29493.1 R29494.1 R29495.1 R29496.1 R29497.1 R29498.1 R29499.1 R29500.1 R29501.1 R29502.1 R29503.1 R29504.1 R29505.1 R29506.1 R29507.1 R29508.1 R29509.1 R29510.1 R29511.1 R29512.1 R29513.1 R29514.1 R29515.1 R29516.1 R29517.1 R29518.1 R29519.1 R29520.1 R29521.1 R29522.1 R29523.1 R29524.1 R29525.1 R29526.1 R29527.1 R29528.1 R29529.1 R29530.1 R29531.1 R29532.1 R29533.1 R29534.1 R29535.1 R29536.1 R29537.1 R29538.1 R29539.1 R29540.1 R29541.1 R29542.1 R29543.1 R29544.1 R29545.1 R29546.1 R29547.1 R29548.1 R29549.1 R29550.1 R29551.1 R29552.1 R29553.1 R29554.1 R29555.1 R29556.1 R29557.1 R29558.1 R29559.1 R29560.1 R29561.1 R29562.1 R29563.1 R29564.1 R29565.1 R29566.1 R29567.1 R29568.1 R29569.1 R29570.1 R29571.1 R29572.1 R29573.1 R29574.1 R29575.1 R29576.1 R29577.1 R29578.1 R29579.1 R29580.1 R29581.1 R29582.1 R29583.1 R29584.1 R29585.1 R29586.1 R29587.1 R29588.1 R29589.1 R29590.1 R29591.1 R29592.1 R29593.1 R29594.1 R29595.1 R29596.1 R29597.1 R29598.1 R29599.1 R29600.1
N$157: R29401.2 R29402.2 R29403.2 R29404.2 R29405.2 R29406.2 R29407.2 R29408.2 R29409.2 R29410.2 R29411.2 R29412.2 R29413.2 R29414.2 R29415.2 R29416.2 R29417.2 R29418.2 R29419.2 R29420.2 R29421.2 R29422.2 R29423.2 R29424.2 R29425.2 R29426.2 R29427.2 R29428.2 R29429.2 R29430.2 R29431.2 R29432.2 R29433.2 R29434.2 R29435.2 R29436.2 R29437.2 R29438.2 R29439.2 R29440.2 R29441.2 R29442.2 R29443.2 R29444.2 R29445.2 R29446.2 R29447.2 R29448.2 R29449.2 R29450.2 R29451.2 R29452.2 R29453.2 R29454.2 R29455.2 R29456.2 R29457.2 R29458.2 R29459.2 R29460.2 R29461.2 R29462.2 R29463.2 R29464.2 R29465.2 R29466.2 R29467.2 R29468.2 R29469.2 R29470.2 R29471.2 R29472.2 R29473.2 R29474.2 R29475.2 R29476.2 R29477.2 R29478.2 R29479.2 R29480.2 R29481.2 R29482.2 R29483.2 R29484.2 R29485.2 R29486.2 R29487.2 R29488.2 R29489.2 R29490.2 R29491.2 R29492.2 R29493.2 R29494.2 R29495.2 R29496.2 R29497.2 R29498.2 R29499.2 R29500.2 R29501.2 R29502.2 R29503.2 R29504.2 R29505.2 R29506.2 R29507.2 R29508.2 R29509.2 R29510.2 R29511.2 R29512.2 R29513.2 R29514.2 R29515.2 R29516.2 R29517.2 R29518.2 R29519.2 R29520.2 R29521.2 R29522.2 R29523.2 R29524.2 R29525.2 R29526.2 R29527.2 R29528.2 R29529.2 R29530.2 R29531.2 R29532.2 R29533.2 R29534.2 R29535.2 R29536.2 R29537.2 R29538.2 R29539.2 R29540.2 R29541.2 R29542.2 R29543.2 R29544.2 R29545.2 R29546.2 R29547.2 R29548.2 R29549.2 R29550.2 R29551.2 R29552.2 R29553.2 R29554.2 R29555.2 R29556.2 R29557.2 R29558.2 R29559.2 R29560.2 R29561.2 R29562.2 R29563.2 R29564.2 R29565.2 R29566.2 R29567.2 R29568.2 R29569.2 R29570.2 R29571.2 R29572.2 R29573.2 R29574.2 R29575.2 R29576.2 R29577.2 R29578.2 R29579.2 R29580.2 R29581.2 R29582.2 R29583.2 R29584.2 R29585.2 R29586.2 R29587.2 R29588.2 R29589.2 R29590.2 R29591.2 R29592.2 R29593.2 R29594.2 R29595.2 R29596.2 R29597.2 R29598.2 R29599.2 R29600.2 R29601.1 R29602.1 R29603.1 R29604.1 R29605.1 R29606.1 R29607.1 R29608.1 R29609.1 R29610.1 R29611.1 R29612.1 R29613.1 R29614.1 R29615.1 R29616.1 R29617.1 R29618.1 R29619.1 R29620.1 R29621.1 R29622.1 R29623.1 R29624.1 R29625.1 R29626.1 R29627.1 R29628.1 R29629.1 R29630.1 R29631.1 R29632.1 R29633.1 R29634.1 R29635.1 R29636.1 R29637.1 R29638.1 R29639.1 R29640.1 R29641.1 R29642.1 R29643.1 R29644.1 R29645.1 R29646.1 R29647.1 R29648.1 R29649.1 R29650.1 R29651.1 R29652.1 R29653.1 R29654.1 R29655.1 R29656.1 R29657.1 R29658.1 R29659.1 R29660.1 R29661.1 R29662.1 R29663.1 R29664.1 R29665.1 R29666.1 R29667.1 R29668.1 R29669.1 R29670.1 R29671.1 R29672.1 R29673.1 R29674.1 R29675.1 R29676.1 R29677.1 R29678.1 R29679.1 R29680.1 R29681.1 R29682.1 R29683.1 R29684.1 R29685.1 R29686.1 R29687.1 R29688.1 R29689.1 R29690.1 R29691.1 R29692.1 R29693.1 R29694.1 R29695.1 R29696.1 R29697.1 R29698.1 R29699.1 R29700.1 R29701.1 R29702.1 R29703.1 R29704.1 R29705.1 R29706.1 R29707.1 R29708.1 R29709.1 R29710.1 R29711.1 R29712.1 R29713.1 R29714.1 R29715.1 R29716.1 R29717.1 R29718.1 R29719.1 R29720.1 R29721.1 R29722.1 R29723.1 R29724.1 R29725.1 R29726.1 R29727.1 R29728.1 R29729.1 R29730.1 R29731.1 R29732.1 R29733.1 R29734.1 R29735.1 R29736.1 R29737.1 R29738.1 R29739.1 R29740.1 R29741.1 R29742.1 R29743.1 R29744.1 R29745.1 R29746.1 R29747.1 R29748.1 R29749.1 R29750.1 R29751.1 R29752.1 R29753.1 R29754.1 R29755.1 R29756.1 R29757.1 R29758.1 R29759.1 R29760.1 R29761.1 R29762.1 R29763.1 R29764.1 R29765.1 R29766.1 R29767.1 R29768.1 R29769.1 R29770.1 R29771.1 R29772.1 R29773.1 R29774.1 R29775.1 R29776.1 R29777.1 R29778.1 R29779.1 R29780.1 R29781.1 R29782.1 R29783.1 R29784.1 R29785.1 R29786.1 R29787.1 R29788.1 R29789.1 R29790.1 R29791.1 R29792.1 R29793.1 R29794.1 R29795.1 R29796.1 R29797.1 R29798.1 R29799.1 R29800.1
N$158: R29601.2 R29602.2 R29603.2 R29604.2 R29605.2 R29606.2 R29607.2 R29608.2 R29609.2 R29610.2 R29611.2 R29612.2 R29613.2 R29614.2 R29615.2 R29616.2 R29617.2 R29618.2 R29619.2 R29620.2 R29621.2 R29622.2 R29623.2 R29624.2 R29625.2 R29626.2 R29627.2 R29628.2 R29629.2 R29630.2 R29631.2 R29632.2 R29633.2 R29634.2 R29635.2 R29636.2 R29637.2 R29638.2 R29639.2 R29640.2 R29641.2 R29642.2 R29643.2 R29644.2 R29645.2 R29646.2 R29647.2 R29648.2 R29649.2 R29650.2 R29651.2 R29652.2 R29653.2 R29654.2 R29655.2 R29656.2 R29657.2 R29658.2 R29659.2 R29660.2 R29661.2 R29662.2 R29663.2 R29664.2 R29665.2 R29666.2 R29667.2 R29668.2 R29669.2 R29670.2 R29671.2 R29672.2 R29673.2 R29674.2 R29675.2 R29676.2 R29677.2 R29678.2 R29679.2 R29680.2 R29681.2 R29682.2 R29683.2 R29684.2 R29685.2 R29686.2 R29687.2 R29688.2 R29689.2 R29690.2 R29691.2 R29692.2 R29693.2 R29694.2 R29695.2 R29696.2 R29697.2 R29698.2 R29699.2 R29700.2 R29701.2 R29702.2 R29703.2 R29704.2 R29705.2 R29706.2 R29707.2 R29708.2 R29709.2 R29710.2 R29711.2 R29712.2 R29713.2 R29714.2 R29715.2 R29716.2 R29717.2 R29718.2 R29719.2 R29720.2 R29721.2 R29722.2 R29723.2 R29724.2 R29725.2 R29726.2 R29727.2 R29728.2 R29729.2 R29730.2 R29731.2 R29732.2 R29733.2 R29734.2 R29735.2 R29736.2 R29737.2 R29738.2 R29739.2 R29740.2 R29741.2 R29742.2 R29743.2 R29744.2 R29745.2 R29746.2 R29747.2 R29748.2 R29749.2 R29750.2 R29751.2 R29752.2 R29753.2 R29754.2 R29755.2 R29756.2 R29757.2 R29758.2 R29759.2 R29760.2 R29761.2 R29762.2 R29763.2 R29764.2 R29765.2 R29766.2 R29767.2 R29768.2 R29769.2 R29770.2 R29771.2 R29772.2 R29773.2 R29774.2 R29775.2 R29776.2 R29777.2 R29778.2 R29779.2 R29780.2 R29781.2 R29782.2 R29783.2 R29784.2 R29785.2 R29786.2 R29787.2 R29788.2 R29789.2 R29790.2 R29791.2 R29792.2 R29793.2 R29794.2 R29795.2 R29796.2 R29797.2 R29798.2 R29799.2 R29800.2 R29801.1 R29802.1 R29803.1 R29804.1 R29805.1 R29806.1 R29807.1 R29808.1 R29809.1 R29810.1 R29811.1 R29812.1 R29813.1 R29814.1 R29815.1 R29816.1 R29817.1 R29818.1 R29819.1 R29820.1 R29821.1 R29822.1 R29823.1 R29824.1 R29825.1 R29826.1 R29827.1 R29828.1 R29829.1 R29830.1 R29831.1 R29832.1 R29833.1 R29834.1 R29835.1 R29836.1 R29837.1 R29838.1 R29839.1 R29840.1 R29841.1 R29842.1 R29843.1 R29844.1 R29845.1 R29846.1 R29847.1 R29848.1 R29849.1 R29850.1 R29851.1 R29852.1 R29853.1 R29854.1 R29855.1 R29856.1 R29857.1 R29858.1 R29859.1 R29860.1 R29861.1 R29862.1 R29863.1 R29864.1 R29865.1 R29866.1 R29867.1 R29868.1 R29869.1 R29870.1 R29871.1 R29872.1 R29873.1 R29874.1 R29875.1 R29876.1 R29877.1 R29878.1 R29879.1 R29880.1 R29881.1 R29882.1 R29883.1 R29884.1 R29885.1 R29886.1 R29887.1 R29888.1 R29889.1 R29890.1 R29891.1 R29892.1 R29893.1 R29894.1 R29895.1 R29896.1 R29897.1 R29898.1 R29899.1 R29900.1 R29901.1 R29902.1 R29903.1 R29904.1 R29905.1 R29906.1 R29907.1 R29908.1 R29909.1 R29910.1 R29911.1 R29912.1 R29913.1 R29914.1 R29915.1 R29916.1 R29917.1 R29918.1 R29919.1 R29920.1 R29921.1 R29922.1 R29923.1 R29924.1 R29925.1 R29926.1 R29927.1 R29928.1 R29929.1 R29930.1 R29931.1 R29932.1 R29933.1 R29934.1 R29935.1 R29936.1 R29937.1 R29938.1 R29939.1 R29940.1 R29941.1 R29942.1 R29943.1 R29944.1 R29945.1 R29946.1 R29947.1 R29948.1 R29949.1 R29950.1 R29951.1 R29952.1 R29953.1 R29954.1 R29955.1 R29956.1 R29957.1 R29958.1 R29959.1 R29960.1 R29961.1 R29962.1 R29963.1 R29964.1 R29965.1 R29966.1 R29967.1 R29968.1 R29969.1 R29970.1 R29971.1 R29972.1 R29973.1 R29974.1 R29975.1 R29976.1 R29977.1 R29978.1 R29979.1 R29980.1 R29981.1 R29982.1 R29983.1 R29984.1 R29985.1 R29986.1 R29987.1 R29988.1 R29989.1 R29990.1 R29991.1 R29992.1 R29993.1 R29994.1 R29995.1 R29996.1 R29997.1 R29998.1 R29999.1 R30000.1
N$159: R29801.2 R29802.2 R29803.2 R29804.2 R29805.2 R29806.2 R29807.2 R29808.2 R29809.2 R29810.2 R29811.2 R29812.2 R29813.2 R29814.2 R29815.2 R29816.2 R29817.2 R29818.2 R29819.2 R29820.2 R29821.2 R29822.2 R29823.2 R29824.2 R29825.2 R29826.2 R29827.2 R29828.2 R29829.2 R29830.2 R29831.2 R29832.2 R29833.2 R29834.2 R29835.2 R29836.2 R29837.2 R29838.2 R29839.2 R29840.2 R29841.2 R29842.2 R29843.2 R29844.2 R29845.2 R29846.2 R29847.2 R29848.2 R29849.2 R29850.2 R29851.2 R29852.2 R29853.2 R29854.2 R29855.2 R29856.2 R29857.2 R29858.2 R29859.2 R29860.2 R29861.2 R29862.2 R29863.2 R29864.2 R29865.2 R29866.2 R29867.2 R29868.2 R29869.2 R29870.2 R29871.2 R29872.2 R29873.2 R29874.2 R29875.2 R29876.2 R29877.2 R29878.2 R29879.2 R29880.2 R29881.2 R29882.2 R29883.2 R29884.2 R29885.2 R29886.2 R29887.2 R29888.2 R29889.2 R29890.2 R29891.2 R29892.2 R29893.2 R29894.2 R29895.2 R29896.2 R29897.2 R29898.2 R29899.2 R29900.2 R29901.2 R29902.2 R29903.2 R29904.2 R29905.2 R29906.2 R29907.2 R29908.2 R29909.2 R29910.2 R29911.2 R29912.2 R29913.2 R29914.2 R29915.2 R29916.2 R29917.2 R29918.2 R29919.2 R29920.2 R29921.2 R29922.2 R29923.2 R29924.2 R29925.2 R29926.2 R29927.2 R29928.2 R29929.2 R29930.2 R29931.2 R29932.2 R29933.2 R29934.2 R29935.2 R29936.2 R29937.2 R29938.2 R29939.2 R29940.2 R29941.2 R29942.2 R29943.2 R29944.2 R29945.2 R29946.2 R29947.2 R29948.2 R29949.2 R29950.2 R29951.2 R29952.2 R29953.2 R29954.2 R29955.2 R29956.2 R29957.2 R29958.2 R29959.2 R29960.2 R29961.2 R29962.2 R29963.2 R29964.2 R29965.2 R29966.2 R29967.2 R29968.2 R29969.2 R29970.2 R29971.2 R29972.2 R29973.2 R29974.2 R29975.2 R29976.2 R29977.2 R29978.2 R29979.2 R29980.2 R29981.2 R29982.2 R29983.2 R29984.2 R29985.2 R29986.2 R29987.2 R29988.2 R29989.2 R29990.2 R29991.2 R29992.2 R29993.2 R29994.2 R29995.2 R29996.2 R29997.2 R29998.2 R29999.2 R30000.2 R30001.1 R30002.1 R30003.1 R30004.1 R30005.1 R30006.1 R30007.1 R30008.1 R30009.1 R30010.1 R30011.1 R30012.1 R30013.1 R30014.1 R30015.1 R30016.1 R30017.1 R30018.1 R30019.1 R30020.1 R30021.1 R30022.1 R30023.1 R30024.1 R30025.1 R30026.1 R30027.1 R30028.1 R30029.1 R30030.1 R30031.1 R30032.1 R30033.1 R30034.1 R30035.1 R30036.1 R30037.1 R30038.1 R30039.1 R30040.1 R30041.1 R30042.1 R30043.1 R30044.1 R30045.1 R30046.1 R30047.1 R30048.1 R30049.1 R30050.1 R30051.1 R30052.1 R30053.1 R30054.1 R30055.1 R30056.1 R30057.1 R30058.1 R30059.1 R30060.1 R30061.1 R30062.1 R30063.1 R30064.1 R30065.1 R30066.1 R30067.1 R30068.1 R30069.1 R30070.1 R30071.1 R30072.1 R30073.1 R30074.1 R30075.1 R30076.1 R30077.1 R30078.1 R30079.1 R30080.1 R30081.1 R30082.1 R30083.1 R30084.1 R30085.1 R30086.1 R30087.1 R30088.1 R30089.1 R30090.1 R30091.1 R30092.1 R30093.1 R30094.1 R30095.1 R30096.1 R30097.1 R30098.1 R30099.1 R30100.1 R30101.1 R30102.1 R30103.1 R30104.1 R30105.1 R30106.1 R30107.1 R30108.1 R30109.1 R30110.1 R30111.1 R30112.1 R30113.1 R30114.1 R30115.1 R30116.1 R30117.1 R30118.1 R30119.1 R30120.1 R30121.1 R30122.1 R30123.1 R30124.1 R30125.1 R30126.1 R30127.1 R30128.1 R30129.1 R30130.1 R30131.1 R30132.1 R30133.1 R30134.1 R30135.1 R30136.1 R30137.1 R30138.1 R30139.1 R30140.1 R30141.1 R30142.1 R30143.1 R30144.1 R30145.1 R30146.1 R30147.1 R30148.1 R30149.1 R30150.1 R30151.1 R30152.1 R30153.1 R30154.1 R30155.1 R30156.1 R30157.1 R30158.1 R30159.1 R30160.1 R30161.1 R30162.1 R30163.1 R30164.1 R30165.1 R30166.1 R30167.1 R30168.1 R30169.1 R30170.1 R30171.1 R30172.1 R30173.1 R30174.1 R30175.1 R30176.1 R30177.1 R30178.1 R30179.1 R30180.1 R30181.1 R30182.1 R30183.1 R30184.1 R30185.1 R30186.1 R30187.1 R30188.1 R30189.1 R30190.1 R30191.1 R30192.1 R30193.1 R30194.1 R30195.1 R30196.1 R30197.1 R30198.1 R30199.1 R30200.1